# EasyEDA Pro project 第十四届蓝桥杯EDA国赛练习2.eprj, board PCB (continued)
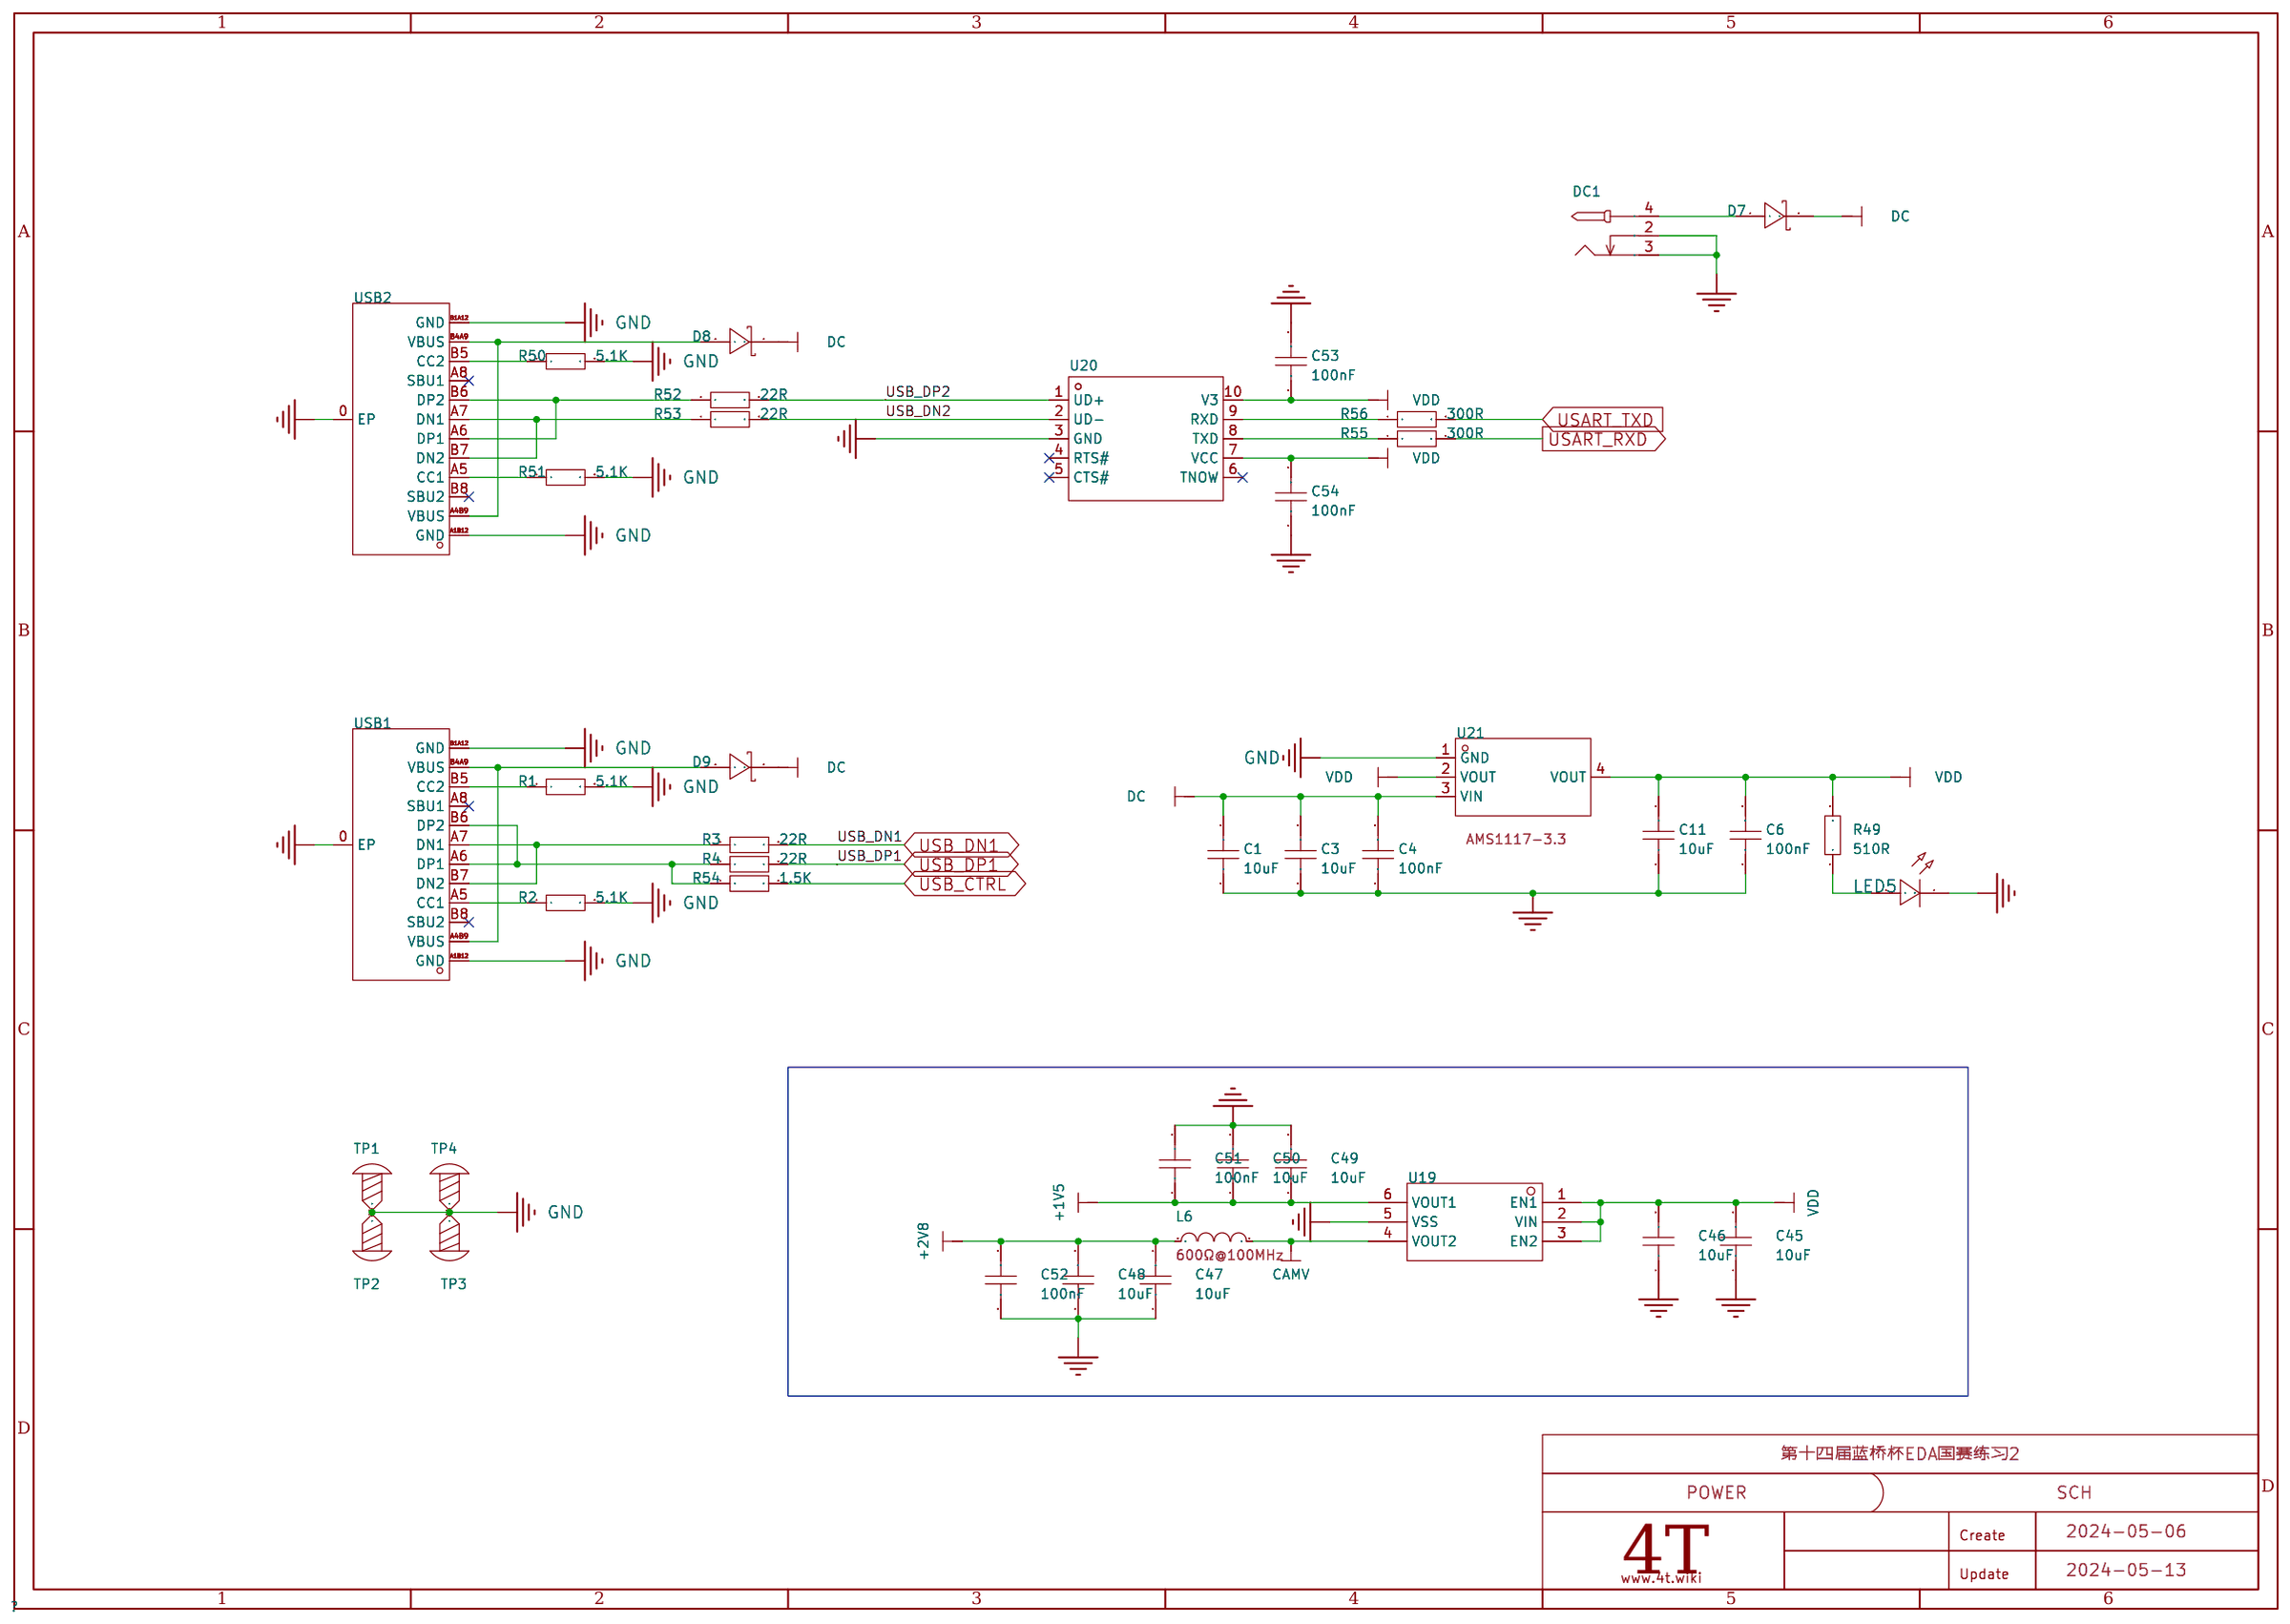
[diagram p0: POWER]
## Routing (per net, layer and track width the routed paths; a pad name or vN(x,y) marks a point on that pad's centre or on a via; arc(x,y) is an arc through that point) (continued)
  Bottom Layer w0.61: v1(13.72,26.17) 13.72,26.16
  vias: v1(13.59,41.02) v1(13.59,40) v1(17.65,44.32) v1(18.67,44.32) v1(22.43,47.75) v1(22.86,44.32) v1(23.75,47.75) v1(23.88,44.32) v1(24.51,53.34) v1(24.51,51.77) v1(24.51,50.2) v1(24.51,48.64) v1(40.89,33.66) v1(40.89,32.64) v1(42.93,27.56) v1(42.93,26.54) v1(43.94,58.43) v1(43.94,57.45) v1(43.94,56.48) v1(46.99,21.43) v1(46.99,20.08) v1(46.99,18.72) v1(46.99,17.36) v1(46.99,16.01) v1(53.97,51.05) v1(53.97,50.04) v1(54.92,51.05) v1(54.95,50.04) v1(54.86,37.34) v1(60.67,52.07) v1(60.71,51.05) v1(61.69,52.07) v1(61.72,51.05)
VDD: length 314.5
  Top Layer w0.203: U14.20 55.28,47.06
  Top Layer w0.254: U17.64 40.83,29.14 40.64,28.96 40.64,26.67 40.13,26.16 C31.1
  Top Layer w0.305: U17.19 57,30.14 57.04,30.1 C30.1 ; U17.48 44.64,40.83 44.07,41.4 42.93,41.4 ; U17.32 56.98,36.64 C29.1 ; 22.02,18.3 22.02,19.35 22.48,19.81 23.79,19.81 U20.7 ; 22.02,18.3 20.29,18.3 C54.2 ; 22.02,18.3 U20.10
  Top Layer w0.61: 64.39,28.07 v1(64.39,22.84) 64.39,13.6 64.4,13.59 ; 64.39,28.07 v1(64.39,37.34) ; 64.39,28.07 64.64,27.81 65.8,27.81 R12.1 ; CN5.1 59.56,54.64 59.56,53.81 ; 64.4,13.59 62.61,13.59 62.21,13.19 R45.2 R44.2 ; 64.4,13.59 65.55,13.59 ; R15.1 66.17,42.04 v1(64.39,42.04) ; 42.93,41.4 42.93,41.51 ; 42.93,41.51 42.93,41.53 C32.1 42.93,41.51 ; 55.28,47.06 C39.1 C40.2 53.21,47.32 52.83,47.7 50.72,47.7 50.42,48.01 R28.2 R29.1 46.96,49.95 46.96,53.37 46.1,54.23 C35.2 v1(44.81,52.8) 44.81,51.58 ; v1(18.67,17.14) 19.13,17.14 20.29,18.3 ; CN11.9 29.62,49.5 v1(30.1,49.02) ; 44.81,51.58 44.81,50.42 44.94,50.29 U13.7 ; 44.81,51.58 44.83,51.56 U13.8 ; R18.1 64.39,56.52 64.13,56.26 64.13,53.97 v1(63.75,53.59) 59.78,53.59 59.56,53.81 ; 20.19,26.67 20.19,28.19 20.83,28.83 25.15,28.83 25.53,29.21 D5.2 25.53,31.24 26.03,31.75 32.45,31.75 ; 20.19,26.67 20.19,18.43 C54.2 ; 20.19,26.67 19.56,27.31 9.4,27.31 R49.2 ; v1(63.75,52.07) 63.75,42.67 v1(64.39,42.04) ; 32.45,31.75 32.45,25.18 33.26,24.37 38.34,24.37 38.86,24.89 38.86,26.05 C31.1 ; 32.45,31.75 R46.1 R47.1 32.6,38.82 ; U13.3 v1(40.51,49.02) ; v1(64.39,42.04) v1(61.47,42.04) ; C29.1 57.04,38.12 57.15,38.23 v1(61.47,38.23) ; C30.1 57.04,26.8 57.02,26.78 v1(57.02,22.82) 57.02,21.97 56.82,21.77 L4.1 ; 59.56,53.81 59.18,53.43 59.18,47.12 58.93,46.86 55.88,46.86 ; C11.2 4.32,28.07 4.57,27.81 6.6,27.81 6.86,28.07 C6.2 ; C45.2 29.45,1.4 26.92,1.4 26.54,1.78 26.54,4.06 26.16,4.44 18.42,4.44 18.16,4.7 v1(18.16,12.57) ; U21.2 U21.4
  Bottom Layer w0.61: v1(18.16,12.57) 18.16,16.64 v1(18.67,17.14) ; v1(61.47,38.23) v1(61.47,42.04) ; H2.2 13.72,54.48 13.97,54.23 28.07,54.23 28.32,53.97 28.32,49.53 28.83,49.02 v1(30.1,49.02) v1(40.51,49.02) ; v1(64.39,22.84) 64.37,22.82 v1(57.02,22.82) ; v1(40.51,49.02) 40.51,50.67 40.77,50.93 44.69,50.93 44.81,51.05 v1(44.81,52.8) ; v1(40.51,49.02) 40.51,48.13 42.93,45.72 42.93,41.66 43.31,41.28 43.94,41.28 v1(44.45,40.77) ; v1(64.39,42.04) v1(64.39,37.34) ; v1(63.75,53.59) v1(63.75,52.07)
  vias: v1(26.54,41.53) v1(26.54,40.51) v1(26.8,50.42) v1(26.8,49.4) v1(27.05,44.32) v1(27.38,41.53) v1(27.4,40.51) v1(27.73,50.42) v1(27.73,49.4) v1(28.07,44.32) v1(28.45,41.53) v1(28.46,40.51) v1(28.86,50.42) v1(28.86,49.4)
VDDA: length 6.4
  Top Layer w0.305: U17.13 50.64,24.15 C16.2 53.82,23.73 L4.2
0: length 129.2
  Top Layer w0.406: 85.85,8.53 85.72,8.4 85.72,7.24 85.3,6.81 82.94,6.81 ; v1(73.53,50.67) 73.53,49.48 Q4.2 73.59,47.55 R20.1 ; 73.32,6.81 73.32,5.22 R11.1 ; 73.32,6.81 Q1.2 73.28,8.25 v1(73.28,9.27) ; 73.32,6.81 82.94,6.81 ; U5.3 v1(65.65,22.48) ; R14.1 73.39,21.24 Q2.2 73.41,21.36 v1(73.41,22.48) ; 82.94,6.81 82.93,6.8 82.93,5.46 ; U3.3 v1(65.65,9.02) ; v1(73.28,38.1) 73.28,37.16 Q3.2 73.34,34.85 73.39,34.8 ; U6.3 v1(65.66,38.1) ; U7.3 v1(66.42,50.67)
  Bottom Layer w0.406: 69.85,9.27 v1(73.28,9.27) ; 69.85,9.27 65.91,9.27 v1(65.65,9.02) ; 69.85,9.27 69.85,22.48 ; 69.83,50.67 v1(73.53,50.67) ; 69.83,50.67 69.81,50.65 69.81,38.1 ; 69.83,50.67 v1(66.42,50.67) ; 69.85,22.48 v1(73.41,22.48) ; 69.85,22.48 69.85,38.06 69.81,38.1 ; 69.81,38.1 v1(73.28,38.1) ; 69.81,38.1 v1(65.66,38.1) ; v1(65.65,22.48) 69.79,22.48
C_CLK: length 46.4
  Top Layer w0.203: v1(60.32,17.14) 62.23,17.14 62.48,17.4 62.48,35.05 61.89,35.64 U17.30 ; FPC1.13 53.72,6.29 v1(53.72,17.4)
  Bottom Layer w0.203: v1(53.72,17.4) 53.97,17.14 v1(60.32,17.14)
C_HSYNC: length 44
  Top Layer w0.203: FPC1.9 55.75,6.26 55.75,7.24 54.99,8 v1(54.99,17.78) ; U17.29 61.85,35.14 62.1,34.89 62.1,18.03 61.85,17.78 v1(59.56,17.78)
  Bottom Layer w0.203: v1(59.56,17.78) v1(54.99,17.78)
C_PCLK: length 62.3
  Top Layer w0.203: FPC1.17 51.69,6.32 51.69,16.38 v1(51.56,16.51) ; v1(56.13,38.99) 62.36,38.99 62.87,38.48 62.87,17.02 62.36,16.51 v1(60.96,16.51) ; v1(48.77,41.15) 49.14,40.78 U17.39
  Bottom Layer w0.203: v1(56.13,38.99) 56.13,40.89 55.88,41.15 v1(48.77,41.15) ; v1(60.96,16.51) v1(51.56,16.51)
C_PWDN: length 49.5
  Top Layer w0.203: U17.28 61.37,34.64 61.72,34.29 61.72,18.62 61.52,18.42 v1(58.8,18.42) 58.8,12.45 59.31,11.94 60.09,11.94 R45.1 ; FPC1.8 56.25,7.5 55.75,8 v1(55.75,18.42)
  Bottom Layer w0.203: v1(55.75,18.42) v1(58.8,18.42)
C_RST: length 46.6
  Top Layer w0.203: U17.26 60.84,33.64 60.96,33.53 60.96,19.89 60.76,19.69 57.53,19.69 57.28,19.43 57.28,6.29 FPC1.6 v1(57.25,4.32) ; R44.1 60.21,5.1 59.44,4.32 v1(59.06,4.32)
  Bottom Layer w0.203: v1(57.25,4.32) v1(59.06,4.32)
C_VSYNC: length 39.4
  Top Layer w0.203: FPC1.7 56.75,6.99 56.64,7.1 v1(56.64,19.05) ; U17.27 61.11,34.14 61.34,33.91 61.34,19.56 60.83,19.05 v1(58.04,19.05)
  Bottom Layer w0.203: v1(56.64,19.05) v1(58.04,19.05)
CAMV: length 10
  Top Layer w0.381: L6.1 33.66,6.35 35.05,4.95 35.69,4.95 36.32,4.32 36.32,2.16 36.67,1.81 U19.4
CIN_1: length 3
  Top Layer w0.203: CN5.5 54.62,53.96 55.28,53.3 U14.6
CIN_2: length 4.7
  Top Layer w0.203: U14.8 54.48,52.83 54.1,53.21 52.45,53.21 52.12,53.54 CN5.7
CIN_3: length 6.5
  Top Layer w0.203: CN5.9 49.66,54.67 49.66,52.7 49.91,52.45 53.47,52.45 53.68,52.23 U14.10
CIN_4: length 3.8
  Top Layer w0.203: CN5.4 55.88,54.69 55.88,53.72 56.26,53.34 56.26,51.44 56.17,51.35 U14.5
COUT_1: length 3.9
  Top Layer w0.203: CN5.6 53.34,54.67 53.34,53.72 53.47,53.59 54.36,53.59 54.88,53.07 U14.7
COUT_2: length 5.5
  Top Layer w0.203: CN5.8 50.88,53.26 51.31,52.83 53.72,52.83 54.08,52.47 U14.9
COUT_3: length 7.5
  Top Layer w0.203: U14.11 51.52,51.35 51.39,51.48 51.39,51.99 51.31,52.07 49.02,52.07 48.39,52.7 48.39,54.69 CN5.10
COUT_4: length 4.7
  Top Layer w0.203: CN5.3 57.12,53.57 57.02,53.47 56.77,53.47 56.64,53.34 56.64,51.18 56.41,50.95 U14.4
CS: length 26.3
  Top Layer w0.203: U13.1 42.42,51.56 42.75,51.23 42.75,46.15 43.05,45.85 51.82,45.85 52.14,45.53 U17.33
D_DATA0: length 28.3
  Top Layer w0.203: v1(47.86,8) 47.86,10.39 48.14,10.67 U17.8 ; v1(50.55,3.94) 50.75,4.14 FPC1.19
  Bottom Layer w0.203: v1(50.55,3.94) 48.06,3.94 47.86,4.14 v1(47.86,8)
D_DATA1: length 25.1
  Top Layer w0.203: U17.9 48.64,10.16 48.51,10.03 v1(48.51,9.65) ; v1(49.78,4.57) 49.78,6.23 FPC1.21
  Bottom Layer w0.203: v1(49.78,4.57) 49.28,4.57 48.51,5.33 v1(48.51,9.65)
D_DATA2: length 20.9
  Top Layer w0.203: U17.10 49.14,8.14 49.28,8 49.28,6.29 FPC1.22
D_DATA3: length 21.1
  Top Layer w0.203: FPC1.20 50.25,7.66 49.64,8.28 U17.11
D_DATA4: length 41.5
  Top Layer w0.203: U17.24 60.07,32.64 60.2,32.51 60.2,20.57 60.07,20.45 51.18,20.45 50.94,20.21 50.94,7.3 51.25,6.99 FPC1.18
D_DATA5: length 41.2
  Top Layer w0.203: U17.25 60.33,33.14 60.58,32.89 60.58,20.27 60.38,20.07 52.58,20.07 52.25,19.74 FPC1.16
D_DATA6: length 65
  Top Layer w0.203: U17.37 50.14,42.06 v1(49.4,42.8) ; v1(52.96,14.86) 52.96,7.75 53.21,7.49 53.21,6.3 FPC1.14 ; v1(62.4,15.11) 63.12,15.11 63.63,15.62 63.63,39.75 63.12,40.26 v1(57.4,40.26)
  Bottom Layer w0.203: v1(62.4,15.11) 62.15,14.86 v1(52.96,14.86) ; v1(57.4,40.26) 57.4,42.42 57.02,42.8 v1(49.4,42.8)
D_DATA7: length 61.8
  Top Layer w0.203: v1(54.36,15.62) 54.25,15.52 FPC1.12 ; v1(61.85,15.88) 62.87,15.88 63.25,16.26 63.25,39.24 62.87,39.62 v1(56.77,39.62) ; v1(49.02,42.04) 49.64,41.42 U17.38
  Bottom Layer w0.203: v1(56.77,39.62) 56.77,41.78 56.51,42.04 v1(49.02,42.04) ; v1(54.36,15.62) 54.61,15.88 v1(61.85,15.88)
DC: length 166.9
  Top Layer w0.61: U21.3 7.13,16.51 ; C24.2 C25.2 83.28,9.4 v1(84.58,9.4) ; C3.2 12.15,16.51 ; C4.2 9.4,16.38 ; C1.2 14.9,16.51
  Top Layer w0.914: v1(24.38,1.02) 24.26,0.89 7.49,0.89 5.48,2.9 5.48,15.88 ; 5.48,15.88 1.78,15.88 1.27,16.38 1.27,52.2 1.91,52.83 11.28,52.83 D9.1 ; 5.48,15.88 8.13,15.88
  Bottom Layer w0.61: U4.2 85.47,8.51 v1(84.58,9.4)
  Bottom Layer w0.914: v1(24.38,1.02) 84.71,1.02 85.47,1.78 U4.2
IO_CTRL1: length 32.7
  Top Layer w0.203: 65.02,11 66.8,12.78 v1(66.8,21.34) ; v1(58.17,21.34) 58.04,21.46 58.04,30.1 57.5,30.64 U17.20
  Bottom Layer w0.203: v1(66.8,21.34) v1(58.17,21.34)
IO_CTRL2: length 16.9
  Top Layer w0.203: U17.21 58.14,31.14 v1(58.67,30.61) ; v1(65.41,26.67) 65.41,25.22 65.4,25.22
  Bottom Layer w0.203: v1(65.41,26.67) 65.41,30.61 v1(58.67,30.61)
IO_CTRL3: length 21.5
  Top Layer w0.203: U17.22 58.65,31.64 v1(58.8,31.5) ; U6.2 65.48,39.88 64.13,39.88 62.99,41.02 v1(59.06,41.02)
  Bottom Layer w0.203: v1(58.8,31.5) 58.8,40.77 v1(59.06,41.02)
IO_CTRL4: length 31.4
  Top Layer w0.203: v1(59.56,32) 59.42,32.14 U17.23 ; v1(59.82,41.78) 59.82,43.24 63.12,46.54 63.12,52.7 63.37,52.96 65.71,52.96 U7.2
  Bottom Layer w0.203: v1(59.56,32) 59.82,32.26 v1(59.82,41.78)
LCD_BLK: length 86.7
  Top Layer w0.203: CN11.7 32.13,54.69 v1(32.13,52.7) ; v1(52.83,25.27) 52.83,29.08 52.89,29.14 U17.17
  Bottom Layer w0.203: 32.13,52.7 32.13,54.61 32.26,54.74 62.1,54.74 62.61,54.23 62.61,34.42 62.87,34.16 66.68,34.16 66.93,33.91 66.93,25.53 66.68,25.27 v1(52.83,25.27)
LCD_CD: length 44.4
  Top Layer w0.203: CN11.5 34.67,54.65 v1(34.67,46.99) ; v1(51.82,35.31) 51.82,35.18 51.64,35 U17.15
  Bottom Layer w0.203: v1(51.82,35.31) 50.67,35.31 50.55,35.43 50.55,38.53 50.34,38.73 35.05,38.73 34.67,39.12 v1(34.67,46.99)
LCD_CS: length 42.6
  Top Layer w0.203: v1(51.18,36.19) 51.14,36.15 U17.14 ; v1(35.94,47.37) 35.94,54.63 CN11.4
  Bottom Layer w0.203: v1(35.94,47.37) 35.94,39.37 36.19,39.12 50.98,39.12 51.18,38.91 v1(51.18,36.19)
LCD_RST: length 46.3
  Top Layer w0.203: v1(52.45,34.54) 52.14,34.23 U17.16 ; CN11.6 33.4,54.67 v1(33.4,46.48)
  Bottom Layer w0.203: v1(52.45,34.54) 50.29,34.54 50.16,34.67 50.16,38.15 49.96,38.35 33.78,38.35 33.4,38.73 v1(33.4,46.48)
LOAD: length 93.1
  Top Layer w0.406: 76.65,16.2 76.65,15.42 76.96,15.11 K2.1 K1.1 85.22,12.7 85.72,12.19 85.72,11.41 C26.1 ; 76.65,16.2 76.4,15.94 R13.2 ; 76.65,16.2 D2.1 76.58,17.39 76.58,18.8 76.33,19.05 75.31,19.05 75.06,19.3 75.06,23.75 74.8,24 v1(73.39,24) ; R10.2 76.12,1.72 76.53,2.13 D1.1 79.93,5 U4.4 ; R19.2 75.97,44.45 D4.1 76.71,42.16 76.84,42.04 v1(82.04,42.04) ; v1(73.39,26.42) R16.2 76.2,31.37 76.58,31.75 76.58,33.1
  Top Layer w0.61: 76.58,33.1 D3.1 76.58,35.18 76.96,35.56 v1(82.04,35.56) 85.09,35.56 K3.1
  Bottom Layer w0.406: U4.4 80.39,12.32 80.77,12.7 84.96,12.7 85.22,12.95 K1.1 ; v1(73.39,26.42) v1(73.39,24) ; v1(82.04,42.04) v1(82.04,35.56)
M_ALERT: length 36.6
  Top Layer w0.203: U17.56 44.19,33.14 44.32,33.27 44.32,36.96 44.21,37.07 41.67,37.07 41.15,37.59 v1(41.15,39.74) 41.2,39.74 41.22,39.77 ; v1(51.69,48.69) 51.69,49.91 51.92,50.15 U14.14
  Bottom Layer w0.203: v1(51.69,48.69) 51.69,50.42 51.44,50.67 48.13,50.67 47.93,50.47 47.93,40.44 47.24,39.74 v1(41.15,39.74)
M_C: length 44
  Top Layer w0.203: v1(20.57,45.72) 20.57,55.88 20.83,56.13 21.7,56.13 21.84,56.28 ; v1(20.57,42.16) 20.89,42.48 45.27,42.48 45.64,42.12 U17.46
  Bottom Layer w0.203: v1(20.57,42.16) v1(20.57,45.72)
M_HX1: length 16
  Top Layer w0.203: U17.5 46.64,25.3 46.23,24.89 42.04,24.89 41.78,24.64 41.8,24.62 R27.1 41.8,22.11 41.4,21.72 41.4,20.97 U12.2 40.75,18.05 41.53,17.27 41.53,16.53 C33.2
M_HX2: length 14.5
  Top Layer w0.203: C34.2 43.84,17.04 44.85,18.05 44.85,20.32 44.07,21.1 44.07,21.83 43.8,22.1 R27.2 43.81,23.51 43.81,24.38 43.94,24.51 46.61,24.51 47.14,25.04 U17.6
M_LX1: length 17.6
  Top Layer w0.203: C36.2 35.34,18.62 35.34,23.4 35.69,23.75 38.61,23.75 40.51,25.65 45.47,25.65 45.64,25.83 U17.3
M_LX2: length 15.4
  Top Layer w0.203: 37.84,21.37 37.84,22.98 38.23,23.37 38.77,23.37 40.67,25.27 45.85,25.27 46.14,25.56 U17.4
  Top Layer w0.254: 37.65,18 37.58,18.07 37.58,20.86
M_RST#: length 37.2
  Top Layer w0.203: C28.1 30.99,22.22 33.12,22.22 33.26,22.37 33.27,22.35 33.27,14.68 33.48,14.48 47.43,14.48 47.64,14.68 U17.7
M_SCL: length 82
  Top Layer w0.203: U14.15 52.41,49.75 52.32,49.66 v1(52.32,49.28) ; R29.2 48.01,50.91 v1(48.01,52.2) ; U17.58 42.65,32.13 v1(50.04,32.13) ; FPC1.5 57.75,12.92 v1(57.91,13.08)
  Bottom Layer w0.203: v1(48.01,52.2) 52.2,52.2 52.32,52.07 v1(52.32,49.28) 52.32,48.77 52.58,48.51 58.17,48.51 58.42,48.26 58.42,33.66 58.29,33.53 50.29,33.53 50.04,33.27 v1(50.04,32.13) 50.04,13.33 50.29,13.08 v1(57.91,13.08)
M_SDA: length 81
  Top Layer w0.203: U14.12 50.33,50.95 50.16,50.78 ; v1(59.06,10.92) 59.06,9.65 58.75,9.35 FPC1.3 ; v1(49.32,49.68) 49.32,50.61 49.44,50.73 49.92,50.73 ; v1(49.28,31.5) 49.13,31.64 U17.59
  Bottom Layer w0.203: v1(59.06,10.92) 49.66,10.92 49.53,11.05 49.53,31.24 v1(49.28,31.5) 49.28,33.66 49.53,33.91 57.78,33.91 58.04,34.16 58.04,46.94 57.61,47.37 51.18,47.37 50.91,47.64 50.91,49.38 50.66,49.63 49.36,49.63 v1(49.32,49.68)
MISO: length 31.4
  Top Layer w0.203: 37.34,50.29 36.96,50.29 36.7,50.04 36.7,45.59 36.83,45.47 50.04,45.47 51.14,44.37 U17.35
  Top Layer w0.305: CN11.3 36.96,54.53 36.96,50.67 37.47,50.17 38.03,50.17 U13.2
MOSI: length 30.1
  Top Layer w0.203: U17.36 50.67,38.68 50.67,43.43 50.55,43.56 v1(48.77,43.56)
  Top Layer w0.406: 43.23,48.08 43.23,52.02 42.93,52.32 38.99,52.32 38.38,52.94 CN11.2 ; 43.23,48.08 43.23,46.81 43.56,46.48 v1(48.64,46.48) ; 43.23,48.08 43.56,47.75 U13.5
  Bottom Layer w0.203: v1(48.77,43.56) 48.64,43.69 v1(48.64,46.48)
OC1A: length 17.8
  Top Layer w0.61: K1.3 85.22,21.59 94.74,12.06 CN1.1
OC1B: length 20.3
  Top Layer w0.61: K1.4 85.22,27.37 94.74,17.84 CN1.2
OC2A: length 20.9
  Bottom Layer w0.61: CN2.1 94.62,22.61 93.47,22.61 92.96,23.11 92.96,26.54 92.2,27.31 80.01,27.31 79.63,26.92 K2.3
OC2B: length 19.6
  Bottom Layer w0.61: CN2.2 94.36,28.19 80.24,28.19 79.63,28.8 K2.4
OC3A: length 15.7
  Top Layer w0.61: CN3.1 94.62,34.42 85.22,43.81 K3.3
OC3B: length 18.2
  Top Layer w0.61: CN3.2 85.22,48.51 K3.4
OC4A: length 20.7
  Bottom Layer w0.61: K4.3 79.5,48.01 80.65,49.15 93.47,49.15 94.11,48.51 94.11,45.85 CN4.1
OC4B: length 16.9
  Bottom Layer w0.61: CN4.2 81.15,50.55 79.5,52.2 K4.4
S_RESET#: length 47.7
  Top Layer w0.203: U17.57 44.71,32.64 44.83,32.77 44.83,36.99 44.36,37.47 42.42,37.47 41.94,37.94 41.94,40.39 v1(41.93,40.39) ; U14.1 58.08,49.75 v1(58.17,49.66)
  Bottom Layer w0.203: v1(41.93,40.39) 41.93,40.32 42.13,40.12 47.08,40.12 47.55,40.59 47.55,40.69 47.36,40.88 47.36,52.7 47.55,52.89 52.77,52.89 53.08,52.58 53.08,49.28 53.34,49.02 58.04,49.02 58.17,49.15 v1(58.17,49.66)
SCK: length 26.7
  Top Layer w0.203: U13.6 46.99,49.02 47.16,48.85 47.16,47.32 47.37,47.12 51.05,47.12 51.44,46.74 v1(51.44,46.61) ; U17.34 51.64,44.88 v1(51.44,45.08)
  Top Layer w0.406: CN11.1 39.62,53.34 40,52.96 43.18,52.96 43.81,52.32 43.81,49.4 44.2,49.02 U13.6
  Bottom Layer w0.203: v1(51.44,45.08) v1(51.44,46.61)
USART_RXD: length 46.2
  Top Layer w0.203: U17.43 47.14,43.1 46.42,43.81 30.1,43.81 v1(29.84,44.07) ; v1(29.97,30.48) 29.97,26.03 29.84,25.91 25.65,25.91 25.53,25.78 R55.2 ; v1(29.97,38.1) v1(29.97,33.15)
  Bottom Layer w0.203: v1(29.97,38.1) 29.97,43.94 v1(29.84,44.07) ; v1(29.97,33.15) v1(29.97,30.48)
USART_TXD: length 45.2
  Top Layer w0.203: 30.73,44.6 v1(30.73,44.45) 30.99,44.7 47.5,44.7 47.64,44.56 U17.42 ; R56.2 28.32,25.4 28.45,25.53 30.1,25.53 30.73,26.16 v1(30.73,30.86) ; v1(30.73,38.48) v1(30.73,32.64)
  Bottom Layer w0.203: v1(30.73,38.48) v1(30.73,44.45) ; v1(30.73,30.86) v1(30.73,32.64)
USB_CTRL: length 52.6
  Top Layer w0.203: U17.41 48.14,44.83 47.88,45.08 15.24,45.08 14.99,44.83 14.99,43.43 14.73,43.18 11.43,43.18 11.18,42.93 11.18,36.32 11.3,36.19 12.11,36.19 R54.2
USB_DN1: length 41.6
  Top Layer w0.254: R3.2 12.23,41.78 15.49,41.78 15.75,42.04 15.75,43.18 15.88,43.31 16.11,43.31 16.36,43.56 17.63,43.56 17.88,43.31 19.15,43.31 19.41,43.56 19.41,43.69 19.66,43.94 20.68,43.94 20.93,43.69 20.93,43.56 21.19,43.31 22.2,43.31 22.45,43.56 23.72,43.56 23.98,43.31 25.25,43.31 25.63,43.69 26.77,43.69 27.15,43.31 46.23,43.31 46.64,42.9 U17.44
USB_DN2: length 8.9
  Top Layer w0.254: U20.2 26.48,18.8 26.05,18.37 26.05,13.07 R53.2
USB_DP1: length 41.8
  Top Layer w0.254: U17.45 46.14,42.76 46.01,42.89 16.48,42.89 16.26,42.67 16.26,39.24 16,38.99 12.18,38.99 R4.2
USB_DP2: length 9
  Top Layer w0.254: U20.1 28.02,18.29 28.01,18.29 26.54,18.29 26.45,18.2 26.45,17.52 26.72,17.25 26.72,15.99 26.45,15.72 26.45,15.1 26.71,14.84 26.8,14.84 27.05,14.59 27.05,13.58 26.8,13.32 26.71,13.32 26.45,13.07 R52.2
$1N757: length 11.7
  Top Layer w0.203: USB1.B5 8.62,43.07 8.89,42.8 8.89,33.53 9.14,33.27 R1.1
$1N782: length 3
  Top Layer w0.203: R2.1 10.03,45.22 10.03,45.85 9.81,46.07 USB1.A5
$1N965: length 10.8
  Top Layer w0.381: D9.2 10.51,47.22 USB1.A4B9 7.19,47.22 6.22,46.25 6.22,43.39 7.19,42.42 USB1.B4A9
$1N986: length 6
  Top Layer w0.203: 8.8,44.57 10.18,43.19 R3.1 ; 8.8,44.57 8.89,44.65 8.89,45.34 8.66,45.57 USB1.B7 ; 8.8,44.57 7.96,44.57
$1N5837: length 2.7
  Top Layer w0.203: 12.07,23.97 11.99,23.89 R49.1
$1N6125: length 1.9
  Top Layer w0.203: 22.53,9.65 22.55,9.63 USB2.A5
$1N6128: length 6.3
  Top Layer w0.203: 30.28,10.03 30.28,9.74 29.3,8.76 25.78,8.76 25.55,8.53 USB2.B5
$1N6129: length 10.9
  Top Layer w0.381: D8.2 19.81,10.41 19.81,9.02 19.94,8.89 21.08,8.89 21.4,8.57 USB2.A4B9 21.4,7.05 22.22,6.22 25.27,6.22 26.2,7.15 USB2.B4A9
$1N6270: length 12
  Top Layer w0.203: USB2.A6 23.55,10.59 24,11.05 26.8,11.05 27.43,10.41 27.43,9.73 27.23,9.53 26.42,9.53 26.03,9.14 25.15,9.14 24.55,8.55 USB2.B6
$1N6277: length 5.2
  Top Layer w0.203: 24.81,9.65 24.63,9.65 24.05,9.06 USB2.A7 24,7.74 24,6.86 23.88,6.73 23.24,6.73 23.05,6.92 USB2.B7
$1N6306: length 12.7
  Top Layer w0.203: USB1.A6 7.94,45.08 7.11,45.08 6.86,44.83 6.86,44.32 7.11,44.07 USB1.B6 8.77,44.07 9.27,43.56 9.27,39.12 9.53,38.86 10.06,38.86 ; 10.06,38.86 10.18,38.74 R54.1 ; 10.06,38.86 R4.1
$1N6538: length 4.7
  Top Layer w0.203: U20.8 25.4,19.3 25.53,19.43 R55.1
$1N6566: length 7.6
  Top Layer w0.203: U20.9 25.66,18.8 26.03,19.18 26.03,21.08 26.16,21.21 28.07,21.21 28.32,21.46 R56.1
$2N490: length 2.6
  Top Layer w0.406: 67.56,11 67.56,13.48 R9.2
$2N1169: length 9.7
  Top Layer w0.406: 71.42,8.21 71.42,1.75 R10.1 71.37,1.7 U3.4
$2N1323: length 24.8
  Top Layer w0.406: v1(77.09,13.72) 76.58,13.72 76.53,13.66 D1.2 76.45,10.2 76.45,12.45 76.2,12.7 72.52,12.7 72.37,12.55 Q1.3
  Bottom Layer w0.406: K1.2 85.09,17.53 82.42,17.53 82.17,17.27 82.17,13.97 81.91,13.72 v1(77.09,13.72)
$2N1681: length 2.8
  Top Layer w0.406: R12.2 68.19,27.68 U5.1
$2N1686: length 8.6
  Top Layer w0.406: U5.4 71.36,15.92 R13.1 71.44,15.99 Q2.1
$2N1700: length 15.8
  Top Layer w0.61: K2.2 79.5,17.78 79.5,20.19 78.99,20.7 76.84,20.7 76.71,20.83 76.71,22.5 ; Q2.3 72.39,24.89 72.52,25.02 76.58,25.02 76.71,24.89 76.71,22.5 ; 76.71,22.5 D2.2
$2N2005: length 2.4
  Top Layer w0.406: R15.2 68.25,39.76 U6.1
$2N2010: length 9.8
  Top Layer w0.406: U6.4 71.17,30.4 71.39,30.62 R16.1 71.44,31.42 Q3.1
$2N2024: length 19.4
  Top Layer w0.406: 76.45,40.89 72.64,40.89 72.39,40.64 Q3.3 ; 76.45,40.89 84.96,40.89 85.22,40.64 K3.2 ; 76.45,40.89 76.58,40.77 D3.2
$2N2329: length 2.8
  Top Layer w0.406: U7.1 68.94,53.69 R18.2
$2N2334: length 7.7
  Top Layer w0.406: U7.4 71.57,44.37 R19.1 71.69,44.5 Q4.1
$2N2348: length 22.1
  Top Layer w0.406: Q4.3 72.64,52.83 72.77,52.96 76.58,52.96 76.71,52.83 D4.2 76.71,48.26 77.98,46.99 v1(77.98,43.18)
  Bottom Layer w0.406: K4.2 78.23,38.23 77.98,38.48 v1(77.98,43.18)
$3N4170: length 3.8
  Top Layer w0.406: H2.1 7.76,58.29 7.49,58.02
$3N4171: length 3.1
  Top Layer w0.457: H2.4 21.83,58.29 21.84,58.28
$3N4361: length 5.6
  Top Layer w0.203: U17.60 40.41,31.14 40.13,30.86 40.13,29.08 40,28.96 R21.2
$3N4426: length 29.6
  Top Layer w0.203: U17.1 44.64,28.52 44.58,28.58 41.66,28.58 41.53,28.45 v1(41.53,26.54)
  Top Layer w0.61: C43.1 28.7,27.83 28.7,26.67 28.57,26.54 v1(28.07,26.54) 25.51,26.54 ; 25.51,26.54 22.99,26.54 22.86,26.67 D6.1 ; 25.51,26.54 25.53,26.56 D5.1
  Bottom Layer w0.305: v1(28.07,26.54) v1(41.53,26.54)
$3N5935: length 54.1
  Top Layer w0.203: v1(14.22,44.32) 14.22,55.63 13.84,56.01 7.25,56.01 R38.2 ; v1(40.77,36.96) 41.08,36.64 U17.49
  Bottom Layer w0.203: v1(40.77,36.96) 14.61,36.96 14.22,37.34 v1(14.22,44.32)
$3N8528: length 6
  Top Layer w0.203: U17.51 40.34,35.64 40.13,35.85 40.13,38.28 39.68,38.73 39.32,38.73 39.32,38.73
$3N8530: length 3.4
  Top Layer w0.203: U17.52 39.49,35.14 LED3.1
$3N8532: length 5.8
  Top Layer w0.203: U17.53 40.36,34.64 40,34.29 40,32 39.88,31.88 39.33,31.88 LED4.1
$3N8599: length 2.5
  Top Layer w0.203: R46.2 37.11,31.9 LED4.2
$3N8602: length 2.5
  Top Layer w0.203: LED3.2 37.11,35.31 R47.2
$3N8605: length 2.8
  Top Layer w0.203: 37.12,38.73 36.86,38.47 34.94,38.47 34.6,38.82
$3N13768: length 18.7
  Top Layer w0.203: FPC1.11 54.75,2.63 54.55,2.43 44.08,2.43 43.69,2.03 R57.1 C55.2
$3N13829: length 22.1
  Top Layer w0.203: v1(58.42,10.16) 58.25,9.99 FPC1.4
  Top Layer w0.305: 46.35,13.19 v1(45.34,13.19) R58.1
  Bottom Layer w0.203: v1(45.34,13.19) 45.35,13.21 48.77,13.21 49.02,12.95 49.02,10.41 49.28,10.16 v1(58.42,10.16)

## Copper pours and planes (outline as drawn; the poured copper is in the pictures)
GND on Top Layer: 41.11,59.18 46.87,59.18 46.87,55.63 41.11,55.63
GND on Top Layer: -10.54,62.99 110.24,62.99 110.24,-5.21 -10.54,-5.21
GND on Top Layer: 21.46,54.61 24.89,54.61 24.89,47.37 21.46,47.37
GND on Bottom Layer: -10.8,65.79 117.6,65.79 117.6,-10.29 -10.8,-10.29
VDD on Top Layer: 25.65,42.04 33.6,42.04 33.6,34.04 25.65,34.04
VDD on Top Layer: 34.15,4.33 35.85,4.33 35.85,2.81 34.15,2.81
VDD on Top Layer: 2.03,28.7 10.29,28.7 10.29,22.22 2.03,22.22
VDD on Top Layer: 29.21,3.18 35.85,3.18 35.85,1.1 29.21,1.1
VDD on Bottom Layer: 25.65,51.18 30.73,51.18 30.73,39.88 25.65,39.88
DC on Top Layer: 6.35,19.96 21.17,19.96 21.17,13.46 6.35,13.46
$1N7582 on Top Layer: 11.68,14.22 17.65,14.22 17.65,8.51 11.68,8.51
$3N3779 on Top Layer: 21.21,36.83 24.38,36.83 24.38,29.46 21.21,29.46

Small or netless copper shapes (teardrops, artwork), in the pictures only: 497 on Top Layer, 114 on Bottom Layer

## Text on the board
Top Silkscreen Layer: P49 | VDD | GND | M_C | LOAD | 0 | DC
